# EAGLE schematic Resistor_Resistor (EAGLE 8.3.0), part 42 of 43
## Nets (continued)
N$186: R35201.2 R35202.2 R35203.2 R35204.2 R35205.2 R35206.2 R35207.2 R35208.2 R35209.2 R35210.2 R35211.2 R35212.2 R35213.2 R35214.2 R35215.2 R35216.2 R35217.2 R35218.2 R35219.2 R35220.2 R35221.2 R35222.2 R35223.2 R35224.2 R35225.2 R35226.2 R35227.2 R35228.2 R35229.2 R35230.2 R35231.2 R35232.2 R35233.2 R35234.2 R35235.2 R35236.2 R35237.2 R35238.2 R35239.2 R35240.2 R35241.2 R35242.2 R35243.2 R35244.2 R35245.2 R35246.2 R35247.2 R35248.2 R35249.2 R35250.2 R35251.2 R35252.2 R35253.2 R35254.2 R35255.2 R35256.2 R35257.2 R35258.2 R35259.2 R35260.2 R35261.2 R35262.2 R35263.2 R35264.2 R35265.2 R35266.2 R35267.2 R35268.2 R35269.2 R35270.2 R35271.2 R35272.2 R35273.2 R35274.2 R35275.2 R35276.2 R35277.2 R35278.2 R35279.2 R35280.2 R35281.2 R35282.2 R35283.2 R35284.2 R35285.2 R35286.2 R35287.2 R35288.2 R35289.2 R35290.2 R35291.2 R35292.2 R35293.2 R35294.2 R35295.2 R35296.2 R35297.2 R35298.2 R35299.2 R35300.2 R35301.2 R35302.2 R35303.2 R35304.2 R35305.2 R35306.2 R35307.2 R35308.2 R35309.2 R35310.2 R35311.2 R35312.2 R35313.2 R35314.2 R35315.2 R35316.2 R35317.2 R35318.2 R35319.2 R35320.2 R35321.2 R35322.2 R35323.2 R35324.2 R35325.2 R35326.2 R35327.2 R35328.2 R35329.2 R35330.2 R35331.2 R35332.2 R35333.2 R35334.2 R35335.2 R35336.2 R35337.2 R35338.2 R35339.2 R35340.2 R35341.2 R35342.2 R35343.2 R35344.2 R35345.2 R35346.2 R35347.2 R35348.2 R35349.2 R35350.2 R35351.2 R35352.2 R35353.2 R35354.2 R35355.2 R35356.2 R35357.2 R35358.2 R35359.2 R35360.2 R35361.2 R35362.2 R35363.2 R35364.2 R35365.2 R35366.2 R35367.2 R35368.2 R35369.2 R35370.2 R35371.2 R35372.2 R35373.2 R35374.2 R35375.2 R35376.2 R35377.2 R35378.2 R35379.2 R35380.2 R35381.2 R35382.2 R35383.2 R35384.2 R35385.2 R35386.2 R35387.2 R35388.2 R35389.2 R35390.2 R35391.2 R35392.2 R35393.2 R35394.2 R35395.2 R35396.2 R35397.2 R35398.2 R35399.2 R35400.2 R35401.1 R35402.1 R35403.1 R35404.1 R35405.1 R35406.1 R35407.1 R35408.1 R35409.1 R35410.1 R35411.1 R35412.1 R35413.1 R35414.1 R35415.1 R35416.1 R35417.1 R35418.1 R35419.1 R35420.1 R35421.1 R35422.1 R35423.1 R35424.1 R35425.1 R35426.1 R35427.1 R35428.1 R35429.1 R35430.1 R35431.1 R35432.1 R35433.1 R35434.1 R35435.1 R35436.1 R35437.1 R35438.1 R35439.1 R35440.1 R35441.1 R35442.1 R35443.1 R35444.1 R35445.1 R35446.1 R35447.1 R35448.1 R35449.1 R35450.1 R35451.1 R35452.1 R35453.1 R35454.1 R35455.1 R35456.1 R35457.1 R35458.1 R35459.1 R35460.1 R35461.1 R35462.1 R35463.1 R35464.1 R35465.1 R35466.1 R35467.1 R35468.1 R35469.1 R35470.1 R35471.1 R35472.1 R35473.1 R35474.1 R35475.1 R35476.1 R35477.1 R35478.1 R35479.1 R35480.1 R35481.1 R35482.1 R35483.1 R35484.1 R35485.1 R35486.1 R35487.1 R35488.1 R35489.1 R35490.1 R35491.1 R35492.1 R35493.1 R35494.1 R35495.1 R35496.1 R35497.1 R35498.1 R35499.1 R35500.1 R35501.1 R35502.1 R35503.1 R35504.1 R35505.1 R35506.1 R35507.1 R35508.1 R35509.1 R35510.1 R35511.1 R35512.1 R35513.1 R35514.1 R35515.1 R35516.1 R35517.1 R35518.1 R35519.1 R35520.1 R35521.1 R35522.1 R35523.1 R35524.1 R35525.1 R35526.1 R35527.1 R35528.1 R35529.1 R35530.1 R35531.1 R35532.1 R35533.1 R35534.1 R35535.1 R35536.1 R35537.1 R35538.1 R35539.1 R35540.1 R35541.1 R35542.1 R35543.1 R35544.1 R35545.1 R35546.1 R35547.1 R35548.1 R35549.1 R35550.1 R35551.1 R35552.1 R35553.1 R35554.1 R35555.1 R35556.1 R35557.1 R35558.1 R35559.1 R35560.1 R35561.1 R35562.1 R35563.1 R35564.1 R35565.1 R35566.1 R35567.1 R35568.1 R35569.1 R35570.1 R35571.1 R35572.1 R35573.1 R35574.1 R35575.1 R35576.1 R35577.1 R35578.1 R35579.1 R35580.1 R35581.1 R35582.1 R35583.1 R35584.1 R35585.1 R35586.1 R35587.1 R35588.1 R35589.1 R35590.1 R35591.1 R35592.1 R35593.1 R35594.1 R35595.1 R35596.1 R35597.1 R35598.1 R35599.1 R35600.1
N$187: R35401.2 R35402.2 R35403.2 R35404.2 R35405.2 R35406.2 R35407.2 R35408.2 R35409.2 R35410.2 R35411.2 R35412.2 R35413.2 R35414.2 R35415.2 R35416.2 R35417.2 R35418.2 R35419.2 R35420.2 R35421.2 R35422.2 R35423.2 R35424.2 R35425.2 R35426.2 R35427.2 R35428.2 R35429.2 R35430.2 R35431.2 R35432.2 R35433.2 R35434.2 R35435.2 R35436.2 R35437.2 R35438.2 R35439.2 R35440.2 R35441.2 R35442.2 R35443.2 R35444.2 R35445.2 R35446.2 R35447.2 R35448.2 R35449.2 R35450.2 R35451.2 R35452.2 R35453.2 R35454.2 R35455.2 R35456.2 R35457.2 R35458.2 R35459.2 R35460.2 R35461.2 R35462.2 R35463.2 R35464.2 R35465.2 R35466.2 R35467.2 R35468.2 R35469.2 R35470.2 R35471.2 R35472.2 R35473.2 R35474.2 R35475.2 R35476.2 R35477.2 R35478.2 R35479.2 R35480.2 R35481.2 R35482.2 R35483.2 R35484.2 R35485.2 R35486.2 R35487.2 R35488.2 R35489.2 R35490.2 R35491.2 R35492.2 R35493.2 R35494.2 R35495.2 R35496.2 R35497.2 R35498.2 R35499.2 R35500.2 R35501.2 R35502.2 R35503.2 R35504.2 R35505.2 R35506.2 R35507.2 R35508.2 R35509.2 R35510.2 R35511.2 R35512.2 R35513.2 R35514.2 R35515.2 R35516.2 R35517.2 R35518.2 R35519.2 R35520.2 R35521.2 R35522.2 R35523.2 R35524.2 R35525.2 R35526.2 R35527.2 R35528.2 R35529.2 R35530.2 R35531.2 R35532.2 R35533.2 R35534.2 R35535.2 R35536.2 R35537.2 R35538.2 R35539.2 R35540.2 R35541.2 R35542.2 R35543.2 R35544.2 R35545.2 R35546.2 R35547.2 R35548.2 R35549.2 R35550.2 R35551.2 R35552.2 R35553.2 R35554.2 R35555.2 R35556.2 R35557.2 R35558.2 R35559.2 R35560.2 R35561.2 R35562.2 R35563.2 R35564.2 R35565.2 R35566.2 R35567.2 R35568.2 R35569.2 R35570.2 R35571.2 R35572.2 R35573.2 R35574.2 R35575.2 R35576.2 R35577.2 R35578.2 R35579.2 R35580.2 R35581.2 R35582.2 R35583.2 R35584.2 R35585.2 R35586.2 R35587.2 R35588.2 R35589.2 R35590.2 R35591.2 R35592.2 R35593.2 R35594.2 R35595.2 R35596.2 R35597.2 R35598.2 R35599.2 R35600.2 R35601.1 R35602.1 R35603.1 R35604.1 R35605.1 R35606.1 R35607.1 R35608.1 R35609.1 R35610.1 R35611.1 R35612.1 R35613.1 R35614.1 R35615.1 R35616.1 R35617.1 R35618.1 R35619.1 R35620.1 R35621.1 R35622.1 R35623.1 R35624.1 R35625.1 R35626.1 R35627.1 R35628.1 R35629.1 R35630.1 R35631.1 R35632.1 R35633.1 R35634.1 R35635.1 R35636.1 R35637.1 R35638.1 R35639.1 R35640.1 R35641.1 R35642.1 R35643.1 R35644.1 R35645.1 R35646.1 R35647.1 R35648.1 R35649.1 R35650.1 R35651.1 R35652.1 R35653.1 R35654.1 R35655.1 R35656.1 R35657.1 R35658.1 R35659.1 R35660.1 R35661.1 R35662.1 R35663.1 R35664.1 R35665.1 R35666.1 R35667.1 R35668.1 R35669.1 R35670.1 R35671.1 R35672.1 R35673.1 R35674.1 R35675.1 R35676.1 R35677.1 R35678.1 R35679.1 R35680.1 R35681.1 R35682.1 R35683.1 R35684.1 R35685.1 R35686.1 R35687.1 R35688.1 R35689.1 R35690.1 R35691.1 R35692.1 R35693.1 R35694.1 R35695.1 R35696.1 R35697.1 R35698.1 R35699.1 R35700.1 R35701.1 R35702.1 R35703.1 R35704.1 R35705.1 R35706.1 R35707.1 R35708.1 R35709.1 R35710.1 R35711.1 R35712.1 R35713.1 R35714.1 R35715.1 R35716.1 R35717.1 R35718.1 R35719.1 R35720.1 R35721.1 R35722.1 R35723.1 R35724.1 R35725.1 R35726.1 R35727.1 R35728.1 R35729.1 R35730.1 R35731.1 R35732.1 R35733.1 R35734.1 R35735.1 R35736.1 R35737.1 R35738.1 R35739.1 R35740.1 R35741.1 R35742.1 R35743.1 R35744.1 R35745.1 R35746.1 R35747.1 R35748.1 R35749.1 R35750.1 R35751.1 R35752.1 R35753.1 R35754.1 R35755.1 R35756.1 R35757.1 R35758.1 R35759.1 R35760.1 R35761.1 R35762.1 R35763.1 R35764.1 R35765.1 R35766.1 R35767.1 R35768.1 R35769.1 R35770.1 R35771.1 R35772.1 R35773.1 R35774.1 R35775.1 R35776.1 R35777.1 R35778.1 R35779.1 R35780.1 R35781.1 R35782.1 R35783.1 R35784.1 R35785.1 R35786.1 R35787.1 R35788.1 R35789.1 R35790.1 R35791.1 R35792.1 R35793.1 R35794.1 R35795.1 R35796.1 R35797.1 R35798.1 R35799.1 R35800.1
N$188: R35601.2 R35602.2 R35603.2 R35604.2 R35605.2 R35606.2 R35607.2 R35608.2 R35609.2 R35610.2 R35611.2 R35612.2 R35613.2 R35614.2 R35615.2 R35616.2 R35617.2 R35618.2 R35619.2 R35620.2 R35621.2 R35622.2 R35623.2 R35624.2 R35625.2 R35626.2 R35627.2 R35628.2 R35629.2 R35630.2 R35631.2 R35632.2 R35633.2 R35634.2 R35635.2 R35636.2 R35637.2 R35638.2 R35639.2 R35640.2 R35641.2 R35642.2 R35643.2 R35644.2 R35645.2 R35646.2 R35647.2 R35648.2 R35649.2 R35650.2 R35651.2 R35652.2 R35653.2 R35654.2 R35655.2 R35656.2 R35657.2 R35658.2 R35659.2 R35660.2 R35661.2 R35662.2 R35663.2 R35664.2 R35665.2 R35666.2 R35667.2 R35668.2 R35669.2 R35670.2 R35671.2 R35672.2 R35673.2 R35674.2 R35675.2 R35676.2 R35677.2 R35678.2 R35679.2 R35680.2 R35681.2 R35682.2 R35683.2 R35684.2 R35685.2 R35686.2 R35687.2 R35688.2 R35689.2 R35690.2 R35691.2 R35692.2 R35693.2 R35694.2 R35695.2 R35696.2 R35697.2 R35698.2 R35699.2 R35700.2 R35701.2 R35702.2 R35703.2 R35704.2 R35705.2 R35706.2 R35707.2 R35708.2 R35709.2 R35710.2 R35711.2 R35712.2 R35713.2 R35714.2 R35715.2 R35716.2 R35717.2 R35718.2 R35719.2 R35720.2 R35721.2 R35722.2 R35723.2 R35724.2 R35725.2 R35726.2 R35727.2 R35728.2 R35729.2 R35730.2 R35731.2 R35732.2 R35733.2 R35734.2 R35735.2 R35736.2 R35737.2 R35738.2 R35739.2 R35740.2 R35741.2 R35742.2 R35743.2 R35744.2 R35745.2 R35746.2 R35747.2 R35748.2 R35749.2 R35750.2 R35751.2 R35752.2 R35753.2 R35754.2 R35755.2 R35756.2 R35757.2 R35758.2 R35759.2 R35760.2 R35761.2 R35762.2 R35763.2 R35764.2 R35765.2 R35766.2 R35767.2 R35768.2 R35769.2 R35770.2 R35771.2 R35772.2 R35773.2 R35774.2 R35775.2 R35776.2 R35777.2 R35778.2 R35779.2 R35780.2 R35781.2 R35782.2 R35783.2 R35784.2 R35785.2 R35786.2 R35787.2 R35788.2 R35789.2 R35790.2 R35791.2 R35792.2 R35793.2 R35794.2 R35795.2 R35796.2 R35797.2 R35798.2 R35799.2 R35800.2 R35801.1 R35802.1 R35803.1 R35804.1 R35805.1 R35806.1 R35807.1 R35808.1 R35809.1 R35810.1 R35811.1 R35812.1 R35813.1 R35814.1 R35815.1 R35816.1 R35817.1 R35818.1 R35819.1 R35820.1 R35821.1 R35822.1 R35823.1 R35824.1 R35825.1 R35826.1 R35827.1 R35828.1 R35829.1 R35830.1 R35831.1 R35832.1 R35833.1 R35834.1 R35835.1 R35836.1 R35837.1 R35838.1 R35839.1 R35840.1 R35841.1 R35842.1 R35843.1 R35844.1 R35845.1 R35846.1 R35847.1 R35848.1 R35849.1 R35850.1 R35851.1 R35852.1 R35853.1 R35854.1 R35855.1 R35856.1 R35857.1 R35858.1 R35859.1 R35860.1 R35861.1 R35862.1 R35863.1 R35864.1 R35865.1 R35866.1 R35867.1 R35868.1 R35869.1 R35870.1 R35871.1 R35872.1 R35873.1 R35874.1 R35875.1 R35876.1 R35877.1 R35878.1 R35879.1 R35880.1 R35881.1 R35882.1 R35883.1 R35884.1 R35885.1 R35886.1 R35887.1 R35888.1 R35889.1 R35890.1 R35891.1 R35892.1 R35893.1 R35894.1 R35895.1 R35896.1 R35897.1 R35898.1 R35899.1 R35900.1 R35901.1 R35902.1 R35903.1 R35904.1 R35905.1 R35906.1 R35907.1 R35908.1 R35909.1 R35910.1 R35911.1 R35912.1 R35913.1 R35914.1 R35915.1 R35916.1 R35917.1 R35918.1 R35919.1 R35920.1 R35921.1 R35922.1 R35923.1 R35924.1 R35925.1 R35926.1 R35927.1 R35928.1 R35929.1 R35930.1 R35931.1 R35932.1 R35933.1 R35934.1 R35935.1 R35936.1 R35937.1 R35938.1 R35939.1 R35940.1 R35941.1 R35942.1 R35943.1 R35944.1 R35945.1 R35946.1 R35947.1 R35948.1 R35949.1 R35950.1 R35951.1 R35952.1 R35953.1 R35954.1 R35955.1 R35956.1 R35957.1 R35958.1 R35959.1 R35960.1 R35961.1 R35962.1 R35963.1 R35964.1 R35965.1 R35966.1 R35967.1 R35968.1 R35969.1 R35970.1 R35971.1 R35972.1 R35973.1 R35974.1 R35975.1 R35976.1 R35977.1 R35978.1 R35979.1 R35980.1 R35981.1 R35982.1 R35983.1 R35984.1 R35985.1 R35986.1 R35987.1 R35988.1 R35989.1 R35990.1 R35991.1 R35992.1 R35993.1 R35994.1 R35995.1 R35996.1 R35997.1 R35998.1 R35999.1 R36000.1
N$189: R35801.2 R35802.2 R35803.2 R35804.2 R35805.2 R35806.2 R35807.2 R35808.2 R35809.2 R35810.2 R35811.2 R35812.2 R35813.2 R35814.2 R35815.2 R35816.2 R35817.2 R35818.2 R35819.2 R35820.2 R35821.2 R35822.2 R35823.2 R35824.2 R35825.2 R35826.2 R35827.2 R35828.2 R35829.2 R35830.2 R35831.2 R35832.2 R35833.2 R35834.2 R35835.2 R35836.2 R35837.2 R35838.2 R35839.2 R35840.2 R35841.2 R35842.2 R35843.2 R35844.2 R35845.2 R35846.2 R35847.2 R35848.2 R35849.2 R35850.2 R35851.2 R35852.2 R35853.2 R35854.2 R35855.2 R35856.2 R35857.2 R35858.2 R35859.2 R35860.2 R35861.2 R35862.2 R35863.2 R35864.2 R35865.2 R35866.2 R35867.2 R35868.2 R35869.2 R35870.2 R35871.2 R35872.2 R35873.2 R35874.2 R35875.2 R35876.2 R35877.2 R35878.2 R35879.2 R35880.2 R35881.2 R35882.2 R35883.2 R35884.2 R35885.2 R35886.2 R35887.2 R35888.2 R35889.2 R35890.2 R35891.2 R35892.2 R35893.2 R35894.2 R35895.2 R35896.2 R35897.2 R35898.2 R35899.2 R35900.2 R35901.2 R35902.2 R35903.2 R35904.2 R35905.2 R35906.2 R35907.2 R35908.2 R35909.2 R35910.2 R35911.2 R35912.2 R35913.2 R35914.2 R35915.2 R35916.2 R35917.2 R35918.2 R35919.2 R35920.2 R35921.2 R35922.2 R35923.2 R35924.2 R35925.2 R35926.2 R35927.2 R35928.2 R35929.2 R35930.2 R35931.2 R35932.2 R35933.2 R35934.2 R35935.2 R35936.2 R35937.2 R35938.2 R35939.2 R35940.2 R35941.2 R35942.2 R35943.2 R35944.2 R35945.2 R35946.2 R35947.2 R35948.2 R35949.2 R35950.2 R35951.2 R35952.2 R35953.2 R35954.2 R35955.2 R35956.2 R35957.2 R35958.2 R35959.2 R35960.2 R35961.2 R35962.2 R35963.2 R35964.2 R35965.2 R35966.2 R35967.2 R35968.2 R35969.2 R35970.2 R35971.2 R35972.2 R35973.2 R35974.2 R35975.2 R35976.2 R35977.2 R35978.2 R35979.2 R35980.2 R35981.2 R35982.2 R35983.2 R35984.2 R35985.2 R35986.2 R35987.2 R35988.2 R35989.2 R35990.2 R35991.2 R35992.2 R35993.2 R35994.2 R35995.2 R35996.2 R35997.2 R35998.2 R35999.2 R36000.2 R36001.1 R36002.1 R36003.1 R36004.1 R36005.1 R36006.1 R36007.1 R36008.1 R36009.1 R36010.1 R36011.1 R36012.1 R36013.1 R36014.1 R36015.1 R36016.1 R36017.1 R36018.1 R36019.1 R36020.1 R36021.1 R36022.1 R36023.1 R36024.1 R36025.1 R36026.1 R36027.1 R36028.1 R36029.1 R36030.1 R36031.1 R36032.1 R36033.1 R36034.1 R36035.1 R36036.1 R36037.1 R36038.1 R36039.1 R36040.1 R36041.1 R36042.1 R36043.1 R36044.1 R36045.1 R36046.1 R36047.1 R36048.1 R36049.1 R36050.1 R36051.1 R36052.1 R36053.1 R36054.1 R36055.1 R36056.1 R36057.1 R36058.1 R36059.1 R36060.1 R36061.1 R36062.1 R36063.1 R36064.1 R36065.1 R36066.1 R36067.1 R36068.1 R36069.1 R36070.1 R36071.1 R36072.1 R36073.1 R36074.1 R36075.1 R36076.1 R36077.1 R36078.1 R36079.1 R36080.1 R36081.1 R36082.1 R36083.1 R36084.1 R36085.1 R36086.1 R36087.1 R36088.1 R36089.1 R36090.1 R36091.1 R36092.1 R36093.1 R36094.1 R36095.1 R36096.1 R36097.1 R36098.1 R36099.1 R36100.1 R36101.1 R36102.1 R36103.1 R36104.1 R36105.1 R36106.1 R36107.1 R36108.1 R36109.1 R36110.1 R36111.1 R36112.1 R36113.1 R36114.1 R36115.1 R36116.1 R36117.1 R36118.1 R36119.1 R36120.1 R36121.1 R36122.1 R36123.1 R36124.1 R36125.1 R36126.1 R36127.1 R36128.1 R36129.1 R36130.1 R36131.1 R36132.1 R36133.1 R36134.1 R36135.1 R36136.1 R36137.1 R36138.1 R36139.1 R36140.1 R36141.1 R36142.1 R36143.1 R36144.1 R36145.1 R36146.1 R36147.1 R36148.1 R36149.1 R36150.1 R36151.1 R36152.1 R36153.1 R36154.1 R36155.1 R36156.1 R36157.1 R36158.1 R36159.1 R36160.1 R36161.1 R36162.1 R36163.1 R36164.1 R36165.1 R36166.1 R36167.1 R36168.1 R36169.1 R36170.1 R36171.1 R36172.1 R36173.1 R36174.1 R36175.1 R36176.1 R36177.1 R36178.1 R36179.1 R36180.1 R36181.1 R36182.1 R36183.1 R36184.1 R36185.1 R36186.1 R36187.1 R36188.1 R36189.1 R36190.1 R36191.1 R36192.1 R36193.1 R36194.1 R36195.1 R36196.1 R36197.1 R36198.1 R36199.1 R36200.1
N$190: R36001.2 R36002.2 R36003.2 R36004.2 R36005.2 R36006.2 R36007.2 R36008.2 R36009.2 R36010.2 R36011.2 R36012.2 R36013.2 R36014.2 R36015.2 R36016.2 R36017.2 R36018.2 R36019.2 R36020.2 R36021.2 R36022.2 R36023.2 R36024.2 R36025.2 R36026.2 R36027.2 R36028.2 R36029.2 R36030.2 R36031.2 R36032.2 R36033.2 R36034.2 R36035.2 R36036.2 R36037.2 R36038.2 R36039.2 R36040.2 R36041.2 R36042.2 R36043.2 R36044.2 R36045.2 R36046.2 R36047.2 R36048.2 R36049.2 R36050.2 R36051.2 R36052.2 R36053.2 R36054.2 R36055.2 R36056.2 R36057.2 R36058.2 R36059.2 R36060.2 R36061.2 R36062.2 R36063.2 R36064.2 R36065.2 R36066.2 R36067.2 R36068.2 R36069.2 R36070.2 R36071.2 R36072.2 R36073.2 R36074.2 R36075.2 R36076.2 R36077.2 R36078.2 R36079.2 R36080.2 R36081.2 R36082.2 R36083.2 R36084.2 R36085.2 R36086.2 R36087.2 R36088.2 R36089.2 R36090.2 R36091.2 R36092.2 R36093.2 R36094.2 R36095.2 R36096.2 R36097.2 R36098.2 R36099.2 R36100.2 R36101.2 R36102.2 R36103.2 R36104.2 R36105.2 R36106.2 R36107.2 R36108.2 R36109.2 R36110.2 R36111.2 R36112.2 R36113.2 R36114.2 R36115.2 R36116.2 R36117.2 R36118.2 R36119.2 R36120.2 R36121.2 R36122.2 R36123.2 R36124.2 R36125.2 R36126.2 R36127.2 R36128.2 R36129.2 R36130.2 R36131.2 R36132.2 R36133.2 R36134.2 R36135.2 R36136.2 R36137.2 R36138.2 R36139.2 R36140.2 R36141.2 R36142.2 R36143.2 R36144.2 R36145.2 R36146.2 R36147.2 R36148.2 R36149.2 R36150.2 R36151.2 R36152.2 R36153.2 R36154.2 R36155.2 R36156.2 R36157.2 R36158.2 R36159.2 R36160.2 R36161.2 R36162.2 R36163.2 R36164.2 R36165.2 R36166.2 R36167.2 R36168.2 R36169.2 R36170.2 R36171.2 R36172.2 R36173.2 R36174.2 R36175.2 R36176.2 R36177.2 R36178.2 R36179.2 R36180.2 R36181.2 R36182.2 R36183.2 R36184.2 R36185.2 R36186.2 R36187.2 R36188.2 R36189.2 R36190.2 R36191.2 R36192.2 R36193.2 R36194.2 R36195.2 R36196.2 R36197.2 R36198.2 R36199.2 R36200.2 R36201.1 R36202.1 R36203.1 R36204.1 R36205.1 R36206.1 R36207.1 R36208.1 R36209.1 R36210.1 R36211.1 R36212.1 R36213.1 R36214.1 R36215.1 R36216.1 R36217.1 R36218.1 R36219.1 R36220.1 R36221.1 R36222.1 R36223.1 R36224.1 R36225.1 R36226.1 R36227.1 R36228.1 R36229.1 R36230.1 R36231.1 R36232.1 R36233.1 R36234.1 R36235.1 R36236.1 R36237.1 R36238.1 R36239.1 R36240.1 R36241.1 R36242.1 R36243.1 R36244.1 R36245.1 R36246.1 R36247.1 R36248.1 R36249.1 R36250.1 R36251.1 R36252.1 R36253.1 R36254.1 R36255.1 R36256.1 R36257.1 R36258.1 R36259.1 R36260.1 R36261.1 R36262.1 R36263.1 R36264.1 R36265.1 R36266.1 R36267.1 R36268.1 R36269.1 R36270.1 R36271.1 R36272.1 R36273.1 R36274.1 R36275.1 R36276.1 R36277.1 R36278.1 R36279.1 R36280.1 R36281.1 R36282.1 R36283.1 R36284.1 R36285.1 R36286.1 R36287.1 R36288.1 R36289.1 R36290.1 R36291.1 R36292.1 R36293.1 R36294.1 R36295.1 R36296.1 R36297.1 R36298.1 R36299.1 R36300.1 R36301.1 R36302.1 R36303.1 R36304.1 R36305.1 R36306.1 R36307.1 R36308.1 R36309.1 R36310.1 R36311.1 R36312.1 R36313.1 R36314.1 R36315.1 R36316.1 R36317.1 R36318.1 R36319.1 R36320.1 R36321.1 R36322.1 R36323.1 R36324.1 R36325.1 R36326.1 R36327.1 R36328.1 R36329.1 R36330.1 R36331.1 R36332.1 R36333.1 R36334.1 R36335.1 R36336.1 R36337.1 R36338.1 R36339.1 R36340.1 R36341.1 R36342.1 R36343.1 R36344.1 R36345.1 R36346.1 R36347.1 R36348.1 R36349.1 R36350.1 R36351.1 R36352.1 R36353.1 R36354.1 R36355.1 R36356.1 R36357.1 R36358.1 R36359.1 R36360.1 R36361.1 R36362.1 R36363.1 R36364.1 R36365.1 R36366.1 R36367.1 R36368.1 R36369.1 R36370.1 R36371.1 R36372.1 R36373.1 R36374.1 R36375.1 R36376.1 R36377.1 R36378.1 R36379.1 R36380.1 R36381.1 R36382.1 R36383.1 R36384.1 R36385.1 R36386.1 R36387.1 R36388.1 R36389.1 R36390.1 R36391.1 R36392.1 R36393.1 R36394.1 R36395.1 R36396.1 R36397.1 R36398.1 R36399.1 R36400.1
N$191: R36201.2 R36202.2 R36203.2 R36204.2 R36205.2 R36206.2 R36207.2 R36208.2 R36209.2 R36210.2 R36211.2 R36212.2 R36213.2 R36214.2 R36215.2 R36216.2 R36217.2 R36218.2 R36219.2 R36220.2 R36221.2 R36222.2 R36223.2 R36224.2 R36225.2 R36226.2 R36227.2 R36228.2 R36229.2 R36230.2 R36231.2 R36232.2 R36233.2 R36234.2 R36235.2 R36236.2 R36237.2 R36238.2 R36239.2 R36240.2 R36241.2 R36242.2 R36243.2 R36244.2 R36245.2 R36246.2 R36247.2 R36248.2 R36249.2 R36250.2 R36251.2 R36252.2 R36253.2 R36254.2 R36255.2 R36256.2 R36257.2 R36258.2 R36259.2 R36260.2 R36261.2 R36262.2 R36263.2 R36264.2 R36265.2 R36266.2 R36267.2 R36268.2 R36269.2 R36270.2 R36271.2 R36272.2 R36273.2 R36274.2 R36275.2 R36276.2 R36277.2 R36278.2 R36279.2 R36280.2 R36281.2 R36282.2 R36283.2 R36284.2 R36285.2 R36286.2 R36287.2 R36288.2 R36289.2 R36290.2 R36291.2 R36292.2 R36293.2 R36294.2 R36295.2 R36296.2 R36297.2 R36298.2 R36299.2 R36300.2 R36301.2 R36302.2 R36303.2 R36304.2 R36305.2 R36306.2 R36307.2 R36308.2 R36309.2 R36310.2 R36311.2 R36312.2 R36313.2 R36314.2 R36315.2 R36316.2 R36317.2 R36318.2 R36319.2 R36320.2 R36321.2 R36322.2 R36323.2 R36324.2 R36325.2 R36326.2 R36327.2 R36328.2 R36329.2 R36330.2 R36331.2 R36332.2 R36333.2 R36334.2 R36335.2 R36336.2 R36337.2 R36338.2 R36339.2 R36340.2 R36341.2 R36342.2 R36343.2 R36344.2 R36345.2 R36346.2 R36347.2 R36348.2 R36349.2 R36350.2 R36351.2 R36352.2 R36353.2 R36354.2 R36355.2 R36356.2 R36357.2 R36358.2 R36359.2 R36360.2 R36361.2 R36362.2 R36363.2 R36364.2 R36365.2 R36366.2 R36367.2 R36368.2 R36369.2 R36370.2 R36371.2 R36372.2 R36373.2 R36374.2 R36375.2 R36376.2 R36377.2 R36378.2 R36379.2 R36380.2 R36381.2 R36382.2 R36383.2 R36384.2 R36385.2 R36386.2 R36387.2 R36388.2 R36389.2 R36390.2 R36391.2 R36392.2 R36393.2 R36394.2 R36395.2 R36396.2 R36397.2 R36398.2 R36399.2 R36400.2 R36401.1 R36402.1 R36403.1 R36404.1 R36405.1 R36406.1 R36407.1 R36408.1 R36409.1 R36410.1 R36411.1 R36412.1 R36413.1 R36414.1 R36415.1 R36416.1 R36417.1 R36418.1 R36419.1 R36420.1 R36421.1 R36422.1 R36423.1 R36424.1 R36425.1 R36426.1 R36427.1 R36428.1 R36429.1 R36430.1 R36431.1 R36432.1 R36433.1 R36434.1 R36435.1 R36436.1 R36437.1 R36438.1 R36439.1 R36440.1 R36441.1 R36442.1 R36443.1 R36444.1 R36445.1 R36446.1 R36447.1 R36448.1 R36449.1 R36450.1 R36451.1 R36452.1 R36453.1 R36454.1 R36455.1 R36456.1 R36457.1 R36458.1 R36459.1 R36460.1 R36461.1 R36462.1 R36463.1 R36464.1 R36465.1 R36466.1 R36467.1 R36468.1 R36469.1 R36470.1 R36471.1 R36472.1 R36473.1 R36474.1 R36475.1 R36476.1 R36477.1 R36478.1 R36479.1 R36480.1 R36481.1 R36482.1 R36483.1 R36484.1 R36485.1 R36486.1 R36487.1 R36488.1 R36489.1 R36490.1 R36491.1 R36492.1 R36493.1 R36494.1 R36495.1 R36496.1 R36497.1 R36498.1 R36499.1 R36500.1 R36501.1 R36502.1 R36503.1 R36504.1 R36505.1 R36506.1 R36507.1 R36508.1 R36509.1 R36510.1 R36511.1 R36512.1 R36513.1 R36514.1 R36515.1 R36516.1 R36517.1 R36518.1 R36519.1 R36520.1 R36521.1 R36522.1 R36523.1 R36524.1 R36525.1 R36526.1 R36527.1 R36528.1 R36529.1 R36530.1 R36531.1 R36532.1 R36533.1 R36534.1 R36535.1 R36536.1 R36537.1 R36538.1 R36539.1 R36540.1 R36541.1 R36542.1 R36543.1 R36544.1 R36545.1 R36546.1 R36547.1 R36548.1 R36549.1 R36550.1 R36551.1 R36552.1 R36553.1 R36554.1 R36555.1 R36556.1 R36557.1 R36558.1 R36559.1 R36560.1 R36561.1 R36562.1 R36563.1 R36564.1 R36565.1 R36566.1 R36567.1 R36568.1 R36569.1 R36570.1 R36571.1 R36572.1 R36573.1 R36574.1 R36575.1 R36576.1 R36577.1 R36578.1 R36579.1 R36580.1 R36581.1 R36582.1 R36583.1 R36584.1 R36585.1 R36586.1 R36587.1 R36588.1 R36589.1 R36590.1 R36591.1 R36592.1 R36593.1 R36594.1 R36595.1 R36596.1 R36597.1 R36598.1 R36599.1 R36600.1
N$192: R36401.2 R36402.2 R36403.2 R36404.2 R36405.2 R36406.2 R36407.2 R36408.2 R36409.2 R36410.2 R36411.2 R36412.2 R36413.2 R36414.2 R36415.2 R36416.2 R36417.2 R36418.2 R36419.2 R36420.2 R36421.2 R36422.2 R36423.2 R36424.2 R36425.2 R36426.2 R36427.2 R36428.2 R36429.2 R36430.2 R36431.2 R36432.2 R36433.2 R36434.2 R36435.2 R36436.2 R36437.2 R36438.2 R36439.2 R36440.2 R36441.2 R36442.2 R36443.2 R36444.2 R36445.2 R36446.2 R36447.2 R36448.2 R36449.2 R36450.2 R36451.2 R36452.2 R36453.2 R36454.2 R36455.2 R36456.2 R36457.2 R36458.2 R36459.2 R36460.2 R36461.2 R36462.2 R36463.2 R36464.2 R36465.2 R36466.2 R36467.2 R36468.2 R36469.2 R36470.2 R36471.2 R36472.2 R36473.2 R36474.2 R36475.2 R36476.2 R36477.2 R36478.2 R36479.2 R36480.2 R36481.2 R36482.2 R36483.2 R36484.2 R36485.2 R36486.2 R36487.2 R36488.2 R36489.2 R36490.2 R36491.2 R36492.2 R36493.2 R36494.2 R36495.2 R36496.2 R36497.2 R36498.2 R36499.2 R36500.2 R36501.2 R36502.2 R36503.2 R36504.2 R36505.2 R36506.2 R36507.2 R36508.2 R36509.2 R36510.2 R36511.2 R36512.2 R36513.2 R36514.2 R36515.2 R36516.2 R36517.2 R36518.2 R36519.2 R36520.2 R36521.2 R36522.2 R36523.2 R36524.2 R36525.2 R36526.2 R36527.2 R36528.2 R36529.2 R36530.2 R36531.2 R36532.2 R36533.2 R36534.2 R36535.2 R36536.2 R36537.2 R36538.2 R36539.2 R36540.2 R36541.2 R36542.2 R36543.2 R36544.2 R36545.2 R36546.2 R36547.2 R36548.2 R36549.2 R36550.2 R36551.2 R36552.2 R36553.2 R36554.2 R36555.2 R36556.2 R36557.2 R36558.2 R36559.2 R36560.2 R36561.2 R36562.2 R36563.2 R36564.2 R36565.2 R36566.2 R36567.2 R36568.2 R36569.2 R36570.2 R36571.2 R36572.2 R36573.2 R36574.2 R36575.2 R36576.2 R36577.2 R36578.2 R36579.2 R36580.2 R36581.2 R36582.2 R36583.2 R36584.2 R36585.2 R36586.2 R36587.2 R36588.2 R36589.2 R36590.2 R36591.2 R36592.2 R36593.2 R36594.2 R36595.2 R36596.2 R36597.2 R36598.2 R36599.2 R36600.2 R36601.1 R36602.1 R36603.1 R36604.1 R36605.1 R36606.1 R36607.1 R36608.1 R36609.1 R36610.1 R36611.1 R36612.1 R36613.1 R36614.1 R36615.1 R36616.1 R36617.1 R36618.1 R36619.1 R36620.1 R36621.1 R36622.1 R36623.1 R36624.1 R36625.1 R36626.1 R36627.1 R36628.1 R36629.1 R36630.1 R36631.1 R36632.1 R36633.1 R36634.1 R36635.1 R36636.1 R36637.1 R36638.1 R36639.1 R36640.1 R36641.1 R36642.1 R36643.1 R36644.1 R36645.1 R36646.1 R36647.1 R36648.1 R36649.1 R36650.1 R36651.1 R36652.1 R36653.1 R36654.1 R36655.1 R36656.1 R36657.1 R36658.1 R36659.1 R36660.1 R36661.1 R36662.1 R36663.1 R36664.1 R36665.1 R36666.1 R36667.1 R36668.1 R36669.1 R36670.1 R36671.1 R36672.1 R36673.1 R36674.1 R36675.1 R36676.1 R36677.1 R36678.1 R36679.1 R36680.1 R36681.1 R36682.1 R36683.1 R36684.1 R36685.1 R36686.1 R36687.1 R36688.1 R36689.1 R36690.1 R36691.1 R36692.1 R36693.1 R36694.1 R36695.1 R36696.1 R36697.1 R36698.1 R36699.1 R36700.1 R36701.1 R36702.1 R36703.1 R36704.1 R36705.1 R36706.1 R36707.1 R36708.1 R36709.1 R36710.1 R36711.1 R36712.1 R36713.1 R36714.1 R36715.1 R36716.1 R36717.1 R36718.1 R36719.1 R36720.1 R36721.1 R36722.1 R36723.1 R36724.1 R36725.1 R36726.1 R36727.1 R36728.1 R36729.1 R36730.1 R36731.1 R36732.1 R36733.1 R36734.1 R36735.1 R36736.1 R36737.1 R36738.1 R36739.1 R36740.1 R36741.1 R36742.1 R36743.1 R36744.1 R36745.1 R36746.1 R36747.1 R36748.1 R36749.1 R36750.1 R36751.1 R36752.1 R36753.1 R36754.1 R36755.1 R36756.1 R36757.1 R36758.1 R36759.1 R36760.1 R36761.1 R36762.1 R36763.1 R36764.1 R36765.1 R36766.1 R36767.1 R36768.1 R36769.1 R36770.1 R36771.1 R36772.1 R36773.1 R36774.1 R36775.1 R36776.1 R36777.1 R36778.1 R36779.1 R36780.1 R36781.1 R36782.1 R36783.1 R36784.1 R36785.1 R36786.1 R36787.1 R36788.1 R36789.1 R36790.1 R36791.1 R36792.1 R36793.1 R36794.1 R36795.1 R36796.1 R36797.1 R36798.1 R36799.1 R36800.1
N$193: R36601.2 R36602.2 R36603.2 R36604.2 R36605.2 R36606.2 R36607.2 R36608.2 R36609.2 R36610.2 R36611.2 R36612.2 R36613.2 R36614.2 R36615.2 R36616.2 R36617.2 R36618.2 R36619.2 R36620.2 R36621.2 R36622.2 R36623.2 R36624.2 R36625.2 R36626.2 R36627.2 R36628.2 R36629.2 R36630.2 R36631.2 R36632.2 R36633.2 R36634.2 R36635.2 R36636.2 R36637.2 R36638.2 R36639.2 R36640.2 R36641.2 R36642.2 R36643.2 R36644.2 R36645.2 R36646.2 R36647.2 R36648.2 R36649.2 R36650.2 R36651.2 R36652.2 R36653.2 R36654.2 R36655.2 R36656.2 R36657.2 R36658.2 R36659.2 R36660.2 R36661.2 R36662.2 R36663.2 R36664.2 R36665.2 R36666.2 R36667.2 R36668.2 R36669.2 R36670.2 R36671.2 R36672.2 R36673.2 R36674.2 R36675.2 R36676.2 R36677.2 R36678.2 R36679.2 R36680.2 R36681.2 R36682.2 R36683.2 R36684.2 R36685.2 R36686.2 R36687.2 R36688.2 R36689.2 R36690.2 R36691.2 R36692.2 R36693.2 R36694.2 R36695.2 R36696.2 R36697.2 R36698.2 R36699.2 R36700.2 R36701.2 R36702.2 R36703.2 R36704.2 R36705.2 R36706.2 R36707.2 R36708.2 R36709.2 R36710.2 R36711.2 R36712.2 R36713.2 R36714.2 R36715.2 R36716.2 R36717.2 R36718.2 R36719.2 R36720.2 R36721.2 R36722.2 R36723.2 R36724.2 R36725.2 R36726.2 R36727.2 R36728.2 R36729.2 R36730.2 R36731.2 R36732.2 R36733.2 R36734.2 R36735.2 R36736.2 R36737.2 R36738.2 R36739.2 R36740.2 R36741.2 R36742.2 R36743.2 R36744.2 R36745.2 R36746.2 R36747.2 R36748.2 R36749.2 R36750.2 R36751.2 R36752.2 R36753.2 R36754.2 R36755.2 R36756.2 R36757.2 R36758.2 R36759.2 R36760.2 R36761.2 R36762.2 R36763.2 R36764.2 R36765.2 R36766.2 R36767.2 R36768.2 R36769.2 R36770.2 R36771.2 R36772.2 R36773.2 R36774.2 R36775.2 R36776.2 R36777.2 R36778.2 R36779.2 R36780.2 R36781.2 R36782.2 R36783.2 R36784.2 R36785.2 R36786.2 R36787.2 R36788.2 R36789.2 R36790.2 R36791.2 R36792.2 R36793.2 R36794.2 R36795.2 R36796.2 R36797.2 R36798.2 R36799.2 R36800.2 R36801.1 R36802.1 R36803.1 R36804.1 R36805.1 R36806.1 R36807.1 R36808.1 R36809.1 R36810.1 R36811.1 R36812.1 R36813.1 R36814.1 R36815.1 R36816.1 R36817.1 R36818.1 R36819.1 R36820.1 R36821.1 R36822.1 R36823.1 R36824.1 R36825.1 R36826.1 R36827.1 R36828.1 R36829.1 R36830.1 R36831.1 R36832.1 R36833.1 R36834.1 R36835.1 R36836.1 R36837.1 R36838.1 R36839.1 R36840.1 R36841.1 R36842.1 R36843.1 R36844.1 R36845.1 R36846.1 R36847.1 R36848.1 R36849.1 R36850.1 R36851.1 R36852.1 R36853.1 R36854.1 R36855.1 R36856.1 R36857.1 R36858.1 R36859.1 R36860.1 R36861.1 R36862.1 R36863.1 R36864.1 R36865.1 R36866.1 R36867.1 R36868.1 R36869.1 R36870.1 R36871.1 R36872.1 R36873.1 R36874.1 R36875.1 R36876.1 R36877.1 R36878.1 R36879.1 R36880.1 R36881.1 R36882.1 R36883.1 R36884.1 R36885.1 R36886.1 R36887.1 R36888.1 R36889.1 R36890.1 R36891.1 R36892.1 R36893.1 R36894.1 R36895.1 R36896.1 R36897.1 R36898.1 R36899.1 R36900.1 R36901.1 R36902.1 R36903.1 R36904.1 R36905.1 R36906.1 R36907.1 R36908.1 R36909.1 R36910.1 R36911.1 R36912.1 R36913.1 R36914.1 R36915.1 R36916.1 R36917.1 R36918.1 R36919.1 R36920.1 R36921.1 R36922.1 R36923.1 R36924.1 R36925.1 R36926.1 R36927.1 R36928.1 R36929.1 R36930.1 R36931.1 R36932.1 R36933.1 R36934.1 R36935.1 R36936.1 R36937.1 R36938.1 R36939.1 R36940.1 R36941.1 R36942.1 R36943.1 R36944.1 R36945.1 R36946.1 R36947.1 R36948.1 R36949.1 R36950.1 R36951.1 R36952.1 R36953.1 R36954.1 R36955.1 R36956.1 R36957.1 R36958.1 R36959.1 R36960.1 R36961.1 R36962.1 R36963.1 R36964.1 R36965.1 R36966.1 R36967.1 R36968.1 R36969.1 R36970.1 R36971.1 R36972.1 R36973.1 R36974.1 R36975.1 R36976.1 R36977.1 R36978.1 R36979.1 R36980.1 R36981.1 R36982.1 R36983.1 R36984.1 R36985.1 R36986.1 R36987.1 R36988.1 R36989.1 R36990.1 R36991.1 R36992.1 R36993.1 R36994.1 R36995.1 R36996.1 R36997.1 R36998.1 R36999.1 R37000.1
N$194: R36801.2 R36802.2 R36803.2 R36804.2 R36805.2 R36806.2 R36807.2 R36808.2 R36809.2 R36810.2 R36811.2 R36812.2 R36813.2 R36814.2 R36815.2 R36816.2 R36817.2 R36818.2 R36819.2 R36820.2 R36821.2 R36822.2 R36823.2 R36824.2 R36825.2 R36826.2 R36827.2 R36828.2 R36829.2 R36830.2 R36831.2 R36832.2 R36833.2 R36834.2 R36835.2 R36836.2 R36837.2 R36838.2 R36839.2 R36840.2 R36841.2 R36842.2 R36843.2 R36844.2 R36845.2 R36846.2 R36847.2 R36848.2 R36849.2 R36850.2 R36851.2 R36852.2 R36853.2 R36854.2 R36855.2 R36856.2 R36857.2 R36858.2 R36859.2 R36860.2 R36861.2 R36862.2 R36863.2 R36864.2 R36865.2 R36866.2 R36867.2 R36868.2 R36869.2 R36870.2 R36871.2 R36872.2 R36873.2 R36874.2 R36875.2 R36876.2 R36877.2 R36878.2 R36879.2 R36880.2 R36881.2 R36882.2 R36883.2 R36884.2 R36885.2 R36886.2 R36887.2 R36888.2 R36889.2 R36890.2 R36891.2 R36892.2 R36893.2 R36894.2 R36895.2 R36896.2 R36897.2 R36898.2 R36899.2 R36900.2 R36901.2 R36902.2 R36903.2 R36904.2 R36905.2 R36906.2 R36907.2 R36908.2 R36909.2 R36910.2 R36911.2 R36912.2 R36913.2 R36914.2 R36915.2 R36916.2 R36917.2 R36918.2 R36919.2 R36920.2 R36921.2 R36922.2 R36923.2 R36924.2 R36925.2 R36926.2 R36927.2 R36928.2 R36929.2 R36930.2 R36931.2 R36932.2 R36933.2 R36934.2 R36935.2 R36936.2 R36937.2 R36938.2 R36939.2 R36940.2 R36941.2 R36942.2 R36943.2 R36944.2 R36945.2 R36946.2 R36947.2 R36948.2 R36949.2 R36950.2 R36951.2 R36952.2 R36953.2 R36954.2 R36955.2 R36956.2 R36957.2 R36958.2 R36959.2 R36960.2 R36961.2 R36962.2 R36963.2 R36964.2 R36965.2 R36966.2 R36967.2 R36968.2 R36969.2 R36970.2 R36971.2 R36972.2 R36973.2 R36974.2 R36975.2 R36976.2 R36977.2 R36978.2 R36979.2 R36980.2 R36981.2 R36982.2 R36983.2 R36984.2 R36985.2 R36986.2 R36987.2 R36988.2 R36989.2 R36990.2 R36991.2 R36992.2 R36993.2 R36994.2 R36995.2 R36996.2 R36997.2 R36998.2 R36999.2 R37000.2 R37001.1 R37002.1 R37003.1 R37004.1 R37005.1 R37006.1 R37007.1 R37008.1 R37009.1 R37010.1 R37011.1 R37012.1 R37013.1 R37014.1 R37015.1 R37016.1 R37017.1 R37018.1 R37019.1 R37020.1 R37021.1 R37022.1 R37023.1 R37024.1 R37025.1 R37026.1 R37027.1 R37028.1 R37029.1 R37030.1 R37031.1 R37032.1 R37033.1 R37034.1 R37035.1 R37036.1 R37037.1 R37038.1 R37039.1 R37040.1 R37041.1 R37042.1 R37043.1 R37044.1 R37045.1 R37046.1 R37047.1 R37048.1 R37049.1 R37050.1 R37051.1 R37052.1 R37053.1 R37054.1 R37055.1 R37056.1 R37057.1 R37058.1 R37059.1 R37060.1 R37061.1 R37062.1 R37063.1 R37064.1 R37065.1 R37066.1 R37067.1 R37068.1 R37069.1 R37070.1 R37071.1 R37072.1 R37073.1 R37074.1 R37075.1 R37076.1 R37077.1 R37078.1 R37079.1 R37080.1 R37081.1 R37082.1 R37083.1 R37084.1 R37085.1 R37086.1 R37087.1 R37088.1 R37089.1 R37090.1 R37091.1 R37092.1 R37093.1 R37094.1 R37095.1 R37096.1 R37097.1 R37098.1 R37099.1 R37100.1 R37101.1 R37102.1 R37103.1 R37104.1 R37105.1 R37106.1 R37107.1 R37108.1 R37109.1 R37110.1 R37111.1 R37112.1 R37113.1 R37114.1 R37115.1 R37116.1 R37117.1 R37118.1 R37119.1 R37120.1 R37121.1 R37122.1 R37123.1 R37124.1 R37125.1 R37126.1 R37127.1 R37128.1 R37129.1 R37130.1 R37131.1 R37132.1 R37133.1 R37134.1 R37135.1 R37136.1 R37137.1 R37138.1 R37139.1 R37140.1 R37141.1 R37142.1 R37143.1 R37144.1 R37145.1 R37146.1 R37147.1 R37148.1 R37149.1 R37150.1 R37151.1 R37152.1 R37153.1 R37154.1 R37155.1 R37156.1 R37157.1 R37158.1 R37159.1 R37160.1 R37161.1 R37162.1 R37163.1 R37164.1 R37165.1 R37166.1 R37167.1 R37168.1 R37169.1 R37170.1 R37171.1 R37172.1 R37173.1 R37174.1 R37175.1 R37176.1 R37177.1 R37178.1 R37179.1 R37180.1 R37181.1 R37182.1 R37183.1 R37184.1 R37185.1 R37186.1 R37187.1 R37188.1 R37189.1 R37190.1 R37191.1 R37192.1 R37193.1 R37194.1 R37195.1 R37196.1 R37197.1 R37198.1 R37199.1 R37200.1
N$195: R37001.2 R37002.2 R37003.2 R37004.2 R37005.2 R37006.2 R37007.2 R37008.2 R37009.2 R37010.2 R37011.2 R37012.2 R37013.2 R37014.2 R37015.2 R37016.2 R37017.2 R37018.2 R37019.2 R37020.2 R37021.2 R37022.2 R37023.2 R37024.2 R37025.2 R37026.2 R37027.2 R37028.2 R37029.2 R37030.2 R37031.2 R37032.2 R37033.2 R37034.2 R37035.2 R37036.2 R37037.2 R37038.2 R37039.2 R37040.2 R37041.2 R37042.2 R37043.2 R37044.2 R37045.2 R37046.2 R37047.2 R37048.2 R37049.2 R37050.2 R37051.2 R37052.2 R37053.2 R37054.2 R37055.2 R37056.2 R37057.2 R37058.2 R37059.2 R37060.2 R37061.2 R37062.2 R37063.2 R37064.2 R37065.2 R37066.2 R37067.2 R37068.2 R37069.2 R37070.2 R37071.2 R37072.2 R37073.2 R37074.2 R37075.2 R37076.2 R37077.2 R37078.2 R37079.2 R37080.2 R37081.2 R37082.2 R37083.2 R37084.2 R37085.2 R37086.2 R37087.2 R37088.2 R37089.2 R37090.2 R37091.2 R37092.2 R37093.2 R37094.2 R37095.2 R37096.2 R37097.2 R37098.2 R37099.2 R37100.2 R37101.2 R37102.2 R37103.2 R37104.2 R37105.2 R37106.2 R37107.2 R37108.2 R37109.2 R37110.2 R37111.2 R37112.2 R37113.2 R37114.2 R37115.2 R37116.2 R37117.2 R37118.2 R37119.2 R37120.2 R37121.2 R37122.2 R37123.2 R37124.2 R37125.2 R37126.2 R37127.2 R37128.2 R37129.2 R37130.2 R37131.2 R37132.2 R37133.2 R37134.2 R37135.2 R37136.2 R37137.2 R37138.2 R37139.2 R37140.2 R37141.2 R37142.2 R37143.2 R37144.2 R37145.2 R37146.2 R37147.2 R37148.2 R37149.2 R37150.2 R37151.2 R37152.2 R37153.2 R37154.2 R37155.2 R37156.2 R37157.2 R37158.2 R37159.2 R37160.2 R37161.2 R37162.2 R37163.2 R37164.2 R37165.2 R37166.2 R37167.2 R37168.2 R37169.2 R37170.2 R37171.2 R37172.2 R37173.2 R37174.2 R37175.2 R37176.2 R37177.2 R37178.2 R37179.2 R37180.2 R37181.2 R37182.2 R37183.2 R37184.2 R37185.2 R37186.2 R37187.2 R37188.2 R37189.2 R37190.2 R37191.2 R37192.2 R37193.2 R37194.2 R37195.2 R37196.2 R37197.2 R37198.2 R37199.2 R37200.2 R37201.1 R37202.1 R37203.1 R37204.1 R37205.1 R37206.1 R37207.1 R37208.1 R37209.1 R37210.1 R37211.1 R37212.1 R37213.1 R37214.1 R37215.1 R37216.1 R37217.1 R37218.1 R37219.1 R37220.1 R37221.1 R37222.1 R37223.1 R37224.1 R37225.1 R37226.1 R37227.1 R37228.1 R37229.1 R37230.1 R37231.1 R37232.1 R37233.1 R37234.1 R37235.1 R37236.1 R37237.1 R37238.1 R37239.1 R37240.1 R37241.1 R37242.1 R37243.1 R37244.1 R37245.1 R37246.1 R37247.1 R37248.1 R37249.1 R37250.1 R37251.1 R37252.1 R37253.1 R37254.1 R37255.1 R37256.1 R37257.1 R37258.1 R37259.1 R37260.1 R37261.1 R37262.1 R37263.1 R37264.1 R37265.1 R37266.1 R37267.1 R37268.1 R37269.1 R37270.1 R37271.1 R37272.1 R37273.1 R37274.1 R37275.1 R37276.1 R37277.1 R37278.1 R37279.1 R37280.1 R37281.1 R37282.1 R37283.1 R37284.1 R37285.1 R37286.1 R37287.1 R37288.1 R37289.1 R37290.1 R37291.1 R37292.1 R37293.1 R37294.1 R37295.1 R37296.1 R37297.1 R37298.1 R37299.1 R37300.1 R37301.1 R37302.1 R37303.1 R37304.1 R37305.1 R37306.1 R37307.1 R37308.1 R37309.1 R37310.1 R37311.1 R37312.1 R37313.1 R37314.1 R37315.1 R37316.1 R37317.1 R37318.1 R37319.1 R37320.1 R37321.1 R37322.1 R37323.1 R37324.1 R37325.1 R37326.1 R37327.1 R37328.1 R37329.1 R37330.1 R37331.1 R37332.1 R37333.1 R37334.1 R37335.1 R37336.1 R37337.1 R37338.1 R37339.1 R37340.1 R37341.1 R37342.1 R37343.1 R37344.1 R37345.1 R37346.1 R37347.1 R37348.1 R37349.1 R37350.1 R37351.1 R37352.1 R37353.1 R37354.1 R37355.1 R37356.1 R37357.1 R37358.1 R37359.1 R37360.1 R37361.1 R37362.1 R37363.1 R37364.1 R37365.1 R37366.1 R37367.1 R37368.1 R37369.1 R37370.1 R37371.1 R37372.1 R37373.1 R37374.1 R37375.1 R37376.1 R37377.1 R37378.1 R37379.1 R37380.1 R37381.1 R37382.1 R37383.1 R37384.1 R37385.1 R37386.1 R37387.1 R37388.1 R37389.1 R37390.1 R37391.1 R37392.1 R37393.1 R37394.1 R37395.1 R37396.1 R37397.1 R37398.1 R37399.1 R37400.1
N$196: R37201.2 R37202.2 R37203.2 R37204.2 R37205.2 R37206.2 R37207.2 R37208.2 R37209.2 R37210.2 R37211.2 R37212.2 R37213.2 R37214.2 R37215.2 R37216.2 R37217.2 R37218.2 R37219.2 R37220.2 R37221.2 R37222.2 R37223.2 R37224.2 R37225.2 R37226.2 R37227.2 R37228.2 R37229.2 R37230.2 R37231.2 R37232.2 R37233.2 R37234.2 R37235.2 R37236.2 R37237.2 R37238.2 R37239.2 R37240.2 R37241.2 R37242.2 R37243.2 R37244.2 R37245.2 R37246.2 R37247.2 R37248.2 R37249.2 R37250.2 R37251.2 R37252.2 R37253.2 R37254.2 R37255.2 R37256.2 R37257.2 R37258.2 R37259.2 R37260.2 R37261.2 R37262.2 R37263.2 R37264.2 R37265.2 R37266.2 R37267.2 R37268.2 R37269.2 R37270.2 R37271.2 R37272.2 R37273.2 R37274.2 R37275.2 R37276.2 R37277.2 R37278.2 R37279.2 R37280.2 R37281.2 R37282.2 R37283.2 R37284.2 R37285.2 R37286.2 R37287.2 R37288.2 R37289.2 R37290.2 R37291.2 R37292.2 R37293.2 R37294.2 R37295.2 R37296.2 R37297.2 R37298.2 R37299.2 R37300.2 R37301.2 R37302.2 R37303.2 R37304.2 R37305.2 R37306.2 R37307.2 R37308.2 R37309.2 R37310.2 R37311.2 R37312.2 R37313.2 R37314.2 R37315.2 R37316.2 R37317.2 R37318.2 R37319.2 R37320.2 R37321.2 R37322.2 R37323.2 R37324.2 R37325.2 R37326.2 R37327.2 R37328.2 R37329.2 R37330.2 R37331.2 R37332.2 R37333.2 R37334.2 R37335.2 R37336.2 R37337.2 R37338.2 R37339.2 R37340.2 R37341.2 R37342.2 R37343.2 R37344.2 R37345.2 R37346.2 R37347.2 R37348.2 R37349.2 R37350.2 R37351.2 R37352.2 R37353.2 R37354.2 R37355.2 R37356.2 R37357.2 R37358.2 R37359.2 R37360.2 R37361.2 R37362.2 R37363.2 R37364.2 R37365.2 R37366.2 R37367.2 R37368.2 R37369.2 R37370.2 R37371.2 R37372.2 R37373.2 R37374.2 R37375.2 R37376.2 R37377.2 R37378.2 R37379.2 R37380.2 R37381.2 R37382.2 R37383.2 R37384.2 R37385.2 R37386.2 R37387.2 R37388.2 R37389.2 R37390.2 R37391.2 R37392.2 R37393.2 R37394.2 R37395.2 R37396.2 R37397.2 R37398.2 R37399.2 R37400.2 R37401.1 R37402.1 R37403.1 R37404.1 R37405.1 R37406.1 R37407.1 R37408.1 R37409.1 R37410.1 R37411.1 R37412.1 R37413.1 R37414.1 R37415.1 R37416.1 R37417.1 R37418.1 R37419.1 R37420.1 R37421.1 R37422.1 R37423.1 R37424.1 R37425.1 R37426.1 R37427.1 R37428.1 R37429.1 R37430.1 R37431.1 R37432.1 R37433.1 R37434.1 R37435.1 R37436.1 R37437.1 R37438.1 R37439.1 R37440.1 R37441.1 R37442.1 R37443.1 R37444.1 R37445.1 R37446.1 R37447.1 R37448.1 R37449.1 R37450.1 R37451.1 R37452.1 R37453.1 R37454.1 R37455.1 R37456.1 R37457.1 R37458.1 R37459.1 R37460.1 R37461.1 R37462.1 R37463.1 R37464.1 R37465.1 R37466.1 R37467.1 R37468.1 R37469.1 R37470.1 R37471.1 R37472.1 R37473.1 R37474.1 R37475.1 R37476.1 R37477.1 R37478.1 R37479.1 R37480.1 R37481.1 R37482.1 R37483.1 R37484.1 R37485.1 R37486.1 R37487.1 R37488.1 R37489.1 R37490.1 R37491.1 R37492.1 R37493.1 R37494.1 R37495.1 R37496.1 R37497.1 R37498.1 R37499.1 R37500.1 R37501.1 R37502.1 R37503.1 R37504.1 R37505.1 R37506.1 R37507.1 R37508.1 R37509.1 R37510.1 R37511.1 R37512.1 R37513.1 R37514.1 R37515.1 R37516.1 R37517.1 R37518.1 R37519.1 R37520.1 R37521.1 R37522.1 R37523.1 R37524.1 R37525.1 R37526.1 R37527.1 R37528.1 R37529.1 R37530.1 R37531.1 R37532.1 R37533.1 R37534.1 R37535.1 R37536.1 R37537.1 R37538.1 R37539.1 R37540.1 R37541.1 R37542.1 R37543.1 R37544.1 R37545.1 R37546.1 R37547.1 R37548.1 R37549.1 R37550.1 R37551.1 R37552.1 R37553.1 R37554.1 R37555.1 R37556.1 R37557.1 R37558.1 R37559.1 R37560.1 R37561.1 R37562.1 R37563.1 R37564.1 R37565.1 R37566.1 R37567.1 R37568.1 R37569.1 R37570.1 R37571.1 R37572.1 R37573.1 R37574.1 R37575.1 R37576.1 R37577.1 R37578.1 R37579.1 R37580.1 R37581.1 R37582.1 R37583.1 R37584.1 R37585.1 R37586.1 R37587.1 R37588.1 R37589.1 R37590.1 R37591.1 R37592.1 R37593.1 R37594.1 R37595.1 R37596.1 R37597.1 R37598.1 R37599.1 R37600.1
N$197: R37401.2 R37402.2 R37403.2 R37404.2 R37405.2 R37406.2 R37407.2 R37408.2 R37409.2 R37410.2 R37411.2 R37412.2 R37413.2 R37414.2 R37415.2 R37416.2 R37417.2 R37418.2 R37419.2 R37420.2 R37421.2 R37422.2 R37423.2 R37424.2 R37425.2 R37426.2 R37427.2 R37428.2 R37429.2 R37430.2 R37431.2 R37432.2 R37433.2 R37434.2 R37435.2 R37436.2 R37437.2 R37438.2 R37439.2 R37440.2 R37441.2 R37442.2 R37443.2 R37444.2 R37445.2 R37446.2 R37447.2 R37448.2 R37449.2 R37450.2 R37451.2 R37452.2 R37453.2 R37454.2 R37455.2 R37456.2 R37457.2 R37458.2 R37459.2 R37460.2 R37461.2 R37462.2 R37463.2 R37464.2 R37465.2 R37466.2 R37467.2 R37468.2 R37469.2 R37470.2 R37471.2 R37472.2 R37473.2 R37474.2 R37475.2 R37476.2 R37477.2 R37478.2 R37479.2 R37480.2 R37481.2 R37482.2 R37483.2 R37484.2 R37485.2 R37486.2 R37487.2 R37488.2 R37489.2 R37490.2 R37491.2 R37492.2 R37493.2 R37494.2 R37495.2 R37496.2 R37497.2 R37498.2 R37499.2 R37500.2 R37501.2 R37502.2 R37503.2 R37504.2 R37505.2 R37506.2 R37507.2 R37508.2 R37509.2 R37510.2 R37511.2 R37512.2 R37513.2 R37514.2 R37515.2 R37516.2 R37517.2 R37518.2 R37519.2 R37520.2 R37521.2 R37522.2 R37523.2 R37524.2 R37525.2 R37526.2 R37527.2 R37528.2 R37529.2 R37530.2 R37531.2 R37532.2 R37533.2 R37534.2 R37535.2 R37536.2 R37537.2 R37538.2 R37539.2 R37540.2 R37541.2 R37542.2 R37543.2 R37544.2 R37545.2 R37546.2 R37547.2 R37548.2 R37549.2 R37550.2 R37551.2 R37552.2 R37553.2 R37554.2 R37555.2 R37556.2 R37557.2 R37558.2 R37559.2 R37560.2 R37561.2 R37562.2 R37563.2 R37564.2 R37565.2 R37566.2 R37567.2 R37568.2 R37569.2 R37570.2 R37571.2 R37572.2 R37573.2 R37574.2 R37575.2 R37576.2 R37577.2 R37578.2 R37579.2 R37580.2 R37581.2 R37582.2 R37583.2 R37584.2 R37585.2 R37586.2 R37587.2 R37588.2 R37589.2 R37590.2 R37591.2 R37592.2 R37593.2 R37594.2 R37595.2 R37596.2 R37597.2 R37598.2 R37599.2 R37600.2 R37601.1 R37602.1 R37603.1 R37604.1 R37605.1 R37606.1 R37607.1 R37608.1 R37609.1 R37610.1 R37611.1 R37612.1 R37613.1 R37614.1 R37615.1 R37616.1 R37617.1 R37618.1 R37619.1 R37620.1 R37621.1 R37622.1 R37623.1 R37624.1 R37625.1 R37626.1 R37627.1 R37628.1 R37629.1 R37630.1 R37631.1 R37632.1 R37633.1 R37634.1 R37635.1 R37636.1 R37637.1 R37638.1 R37639.1 R37640.1 R37641.1 R37642.1 R37643.1 R37644.1 R37645.1 R37646.1 R37647.1 R37648.1 R37649.1 R37650.1 R37651.1 R37652.1 R37653.1 R37654.1 R37655.1 R37656.1 R37657.1 R37658.1 R37659.1 R37660.1 R37661.1 R37662.1 R37663.1 R37664.1 R37665.1 R37666.1 R37667.1 R37668.1 R37669.1 R37670.1 R37671.1 R37672.1 R37673.1 R37674.1 R37675.1 R37676.1 R37677.1 R37678.1 R37679.1 R37680.1 R37681.1 R37682.1 R37683.1 R37684.1 R37685.1 R37686.1 R37687.1 R37688.1 R37689.1 R37690.1 R37691.1 R37692.1 R37693.1 R37694.1 R37695.1 R37696.1 R37697.1 R37698.1 R37699.1 R37700.1 R37701.1 R37702.1 R37703.1 R37704.1 R37705.1 R37706.1 R37707.1 R37708.1 R37709.1 R37710.1 R37711.1 R37712.1 R37713.1 R37714.1 R37715.1 R37716.1 R37717.1 R37718.1 R37719.1 R37720.1 R37721.1 R37722.1 R37723.1 R37724.1 R37725.1 R37726.1 R37727.1 R37728.1 R37729.1 R37730.1 R37731.1 R37732.1 R37733.1 R37734.1 R37735.1 R37736.1 R37737.1 R37738.1 R37739.1 R37740.1 R37741.1 R37742.1 R37743.1 R37744.1 R37745.1 R37746.1 R37747.1 R37748.1 R37749.1 R37750.1 R37751.1 R37752.1 R37753.1 R37754.1 R37755.1 R37756.1 R37757.1 R37758.1 R37759.1 R37760.1 R37761.1 R37762.1 R37763.1 R37764.1 R37765.1 R37766.1 R37767.1 R37768.1 R37769.1 R37770.1 R37771.1 R37772.1 R37773.1 R37774.1 R37775.1 R37776.1 R37777.1 R37778.1 R37779.1 R37780.1 R37781.1 R37782.1 R37783.1 R37784.1 R37785.1 R37786.1 R37787.1 R37788.1 R37789.1 R37790.1 R37791.1 R37792.1 R37793.1 R37794.1 R37795.1 R37796.1 R37797.1 R37798.1 R37799.1 R37800.1
N$198: R37601.2 R37602.2 R37603.2 R37604.2 R37605.2 R37606.2 R37607.2 R37608.2 R37609.2 R37610.2 R37611.2 R37612.2 R37613.2 R37614.2 R37615.2 R37616.2 R37617.2 R37618.2 R37619.2 R37620.2 R37621.2 R37622.2 R37623.2 R37624.2 R37625.2 R37626.2 R37627.2 R37628.2 R37629.2 R37630.2 R37631.2 R37632.2 R37633.2 R37634.2 R37635.2 R37636.2 R37637.2 R37638.2 R37639.2 R37640.2 R37641.2 R37642.2 R37643.2 R37644.2 R37645.2 R37646.2 R37647.2 R37648.2 R37649.2 R37650.2 R37651.2 R37652.2 R37653.2 R37654.2 R37655.2 R37656.2 R37657.2 R37658.2 R37659.2 R37660.2 R37661.2 R37662.2 R37663.2 R37664.2 R37665.2 R37666.2 R37667.2 R37668.2 R37669.2 R37670.2 R37671.2 R37672.2 R37673.2 R37674.2 R37675.2 R37676.2 R37677.2 R37678.2 R37679.2 R37680.2 R37681.2 R37682.2 R37683.2 R37684.2 R37685.2 R37686.2 R37687.2 R37688.2 R37689.2 R37690.2 R37691.2 R37692.2 R37693.2 R37694.2 R37695.2 R37696.2 R37697.2 R37698.2 R37699.2 R37700.2 R37701.2 R37702.2 R37703.2 R37704.2 R37705.2 R37706.2 R37707.2 R37708.2 R37709.2 R37710.2 R37711.2 R37712.2 R37713.2 R37714.2 R37715.2 R37716.2 R37717.2 R37718.2 R37719.2 R37720.2 R37721.2 R37722.2 R37723.2 R37724.2 R37725.2 R37726.2 R37727.2 R37728.2 R37729.2 R37730.2 R37731.2 R37732.2 R37733.2 R37734.2 R37735.2 R37736.2 R37737.2 R37738.2 R37739.2 R37740.2 R37741.2 R37742.2 R37743.2 R37744.2 R37745.2 R37746.2 R37747.2 R37748.2 R37749.2 R37750.2 R37751.2 R37752.2 R37753.2 R37754.2 R37755.2 R37756.2 R37757.2 R37758.2 R37759.2 R37760.2 R37761.2 R37762.2 R37763.2 R37764.2 R37765.2 R37766.2 R37767.2 R37768.2 R37769.2 R37770.2 R37771.2 R37772.2 R37773.2 R37774.2 R37775.2 R37776.2 R37777.2 R37778.2 R37779.2 R37780.2 R37781.2 R37782.2 R37783.2 R37784.2 R37785.2 R37786.2 R37787.2 R37788.2 R37789.2 R37790.2 R37791.2 R37792.2 R37793.2 R37794.2 R37795.2 R37796.2 R37797.2 R37798.2 R37799.2 R37800.2 R37801.1 R37802.1 R37803.1 R37804.1 R37805.1 R37806.1 R37807.1 R37808.1 R37809.1 R37810.1 R37811.1 R37812.1 R37813.1 R37814.1 R37815.1 R37816.1 R37817.1 R37818.1 R37819.1 R37820.1 R37821.1 R37822.1 R37823.1 R37824.1 R37825.1 R37826.1 R37827.1 R37828.1 R37829.1 R37830.1 R37831.1 R37832.1 R37833.1 R37834.1 R37835.1 R37836.1 R37837.1 R37838.1 R37839.1 R37840.1 R37841.1 R37842.1 R37843.1 R37844.1 R37845.1 R37846.1 R37847.1 R37848.1 R37849.1 R37850.1 R37851.1 R37852.1 R37853.1 R37854.1 R37855.1 R37856.1 R37857.1 R37858.1 R37859.1 R37860.1 R37861.1 R37862.1 R37863.1 R37864.1 R37865.1 R37866.1 R37867.1 R37868.1 R37869.1 R37870.1 R37871.1 R37872.1 R37873.1 R37874.1 R37875.1 R37876.1 R37877.1 R37878.1 R37879.1 R37880.1 R37881.1 R37882.1 R37883.1 R37884.1 R37885.1 R37886.1 R37887.1 R37888.1 R37889.1 R37890.1 R37891.1 R37892.1 R37893.1 R37894.1 R37895.1 R37896.1 R37897.1 R37898.1 R37899.1 R37900.1 R37901.1 R37902.1 R37903.1 R37904.1 R37905.1 R37906.1 R37907.1 R37908.1 R37909.1 R37910.1 R37911.1 R37912.1 R37913.1 R37914.1 R37915.1 R37916.1 R37917.1 R37918.1 R37919.1 R37920.1 R37921.1 R37922.1 R37923.1 R37924.1 R37925.1 R37926.1 R37927.1 R37928.1 R37929.1 R37930.1 R37931.1 R37932.1 R37933.1 R37934.1 R37935.1 R37936.1 R37937.1 R37938.1 R37939.1 R37940.1 R37941.1 R37942.1 R37943.1 R37944.1 R37945.1 R37946.1 R37947.1 R37948.1 R37949.1 R37950.1 R37951.1 R37952.1 R37953.1 R37954.1 R37955.1 R37956.1 R37957.1 R37958.1 R37959.1 R37960.1 R37961.1 R37962.1 R37963.1 R37964.1 R37965.1 R37966.1 R37967.1 R37968.1 R37969.1 R37970.1 R37971.1 R37972.1 R37973.1 R37974.1 R37975.1 R37976.1 R37977.1 R37978.1 R37979.1 R37980.1 R37981.1 R37982.1 R37983.1 R37984.1 R37985.1 R37986.1 R37987.1 R37988.1 R37989.1 R37990.1 R37991.1 R37992.1 R37993.1 R37994.1 R37995.1 R37996.1 R37997.1 R37998.1 R37999.1 R38000.1